# EasyEDA Pro project 智能布料.eprj

# Schematic Schematic1
Create Date: 2025-07-19; Page Name: P1; Project Name: 智能布料; Schematic Name: Schematic1; Update Date: 2025-07-20; Company: 嘉立创EDA; Page Size: A4; Version: V1.0
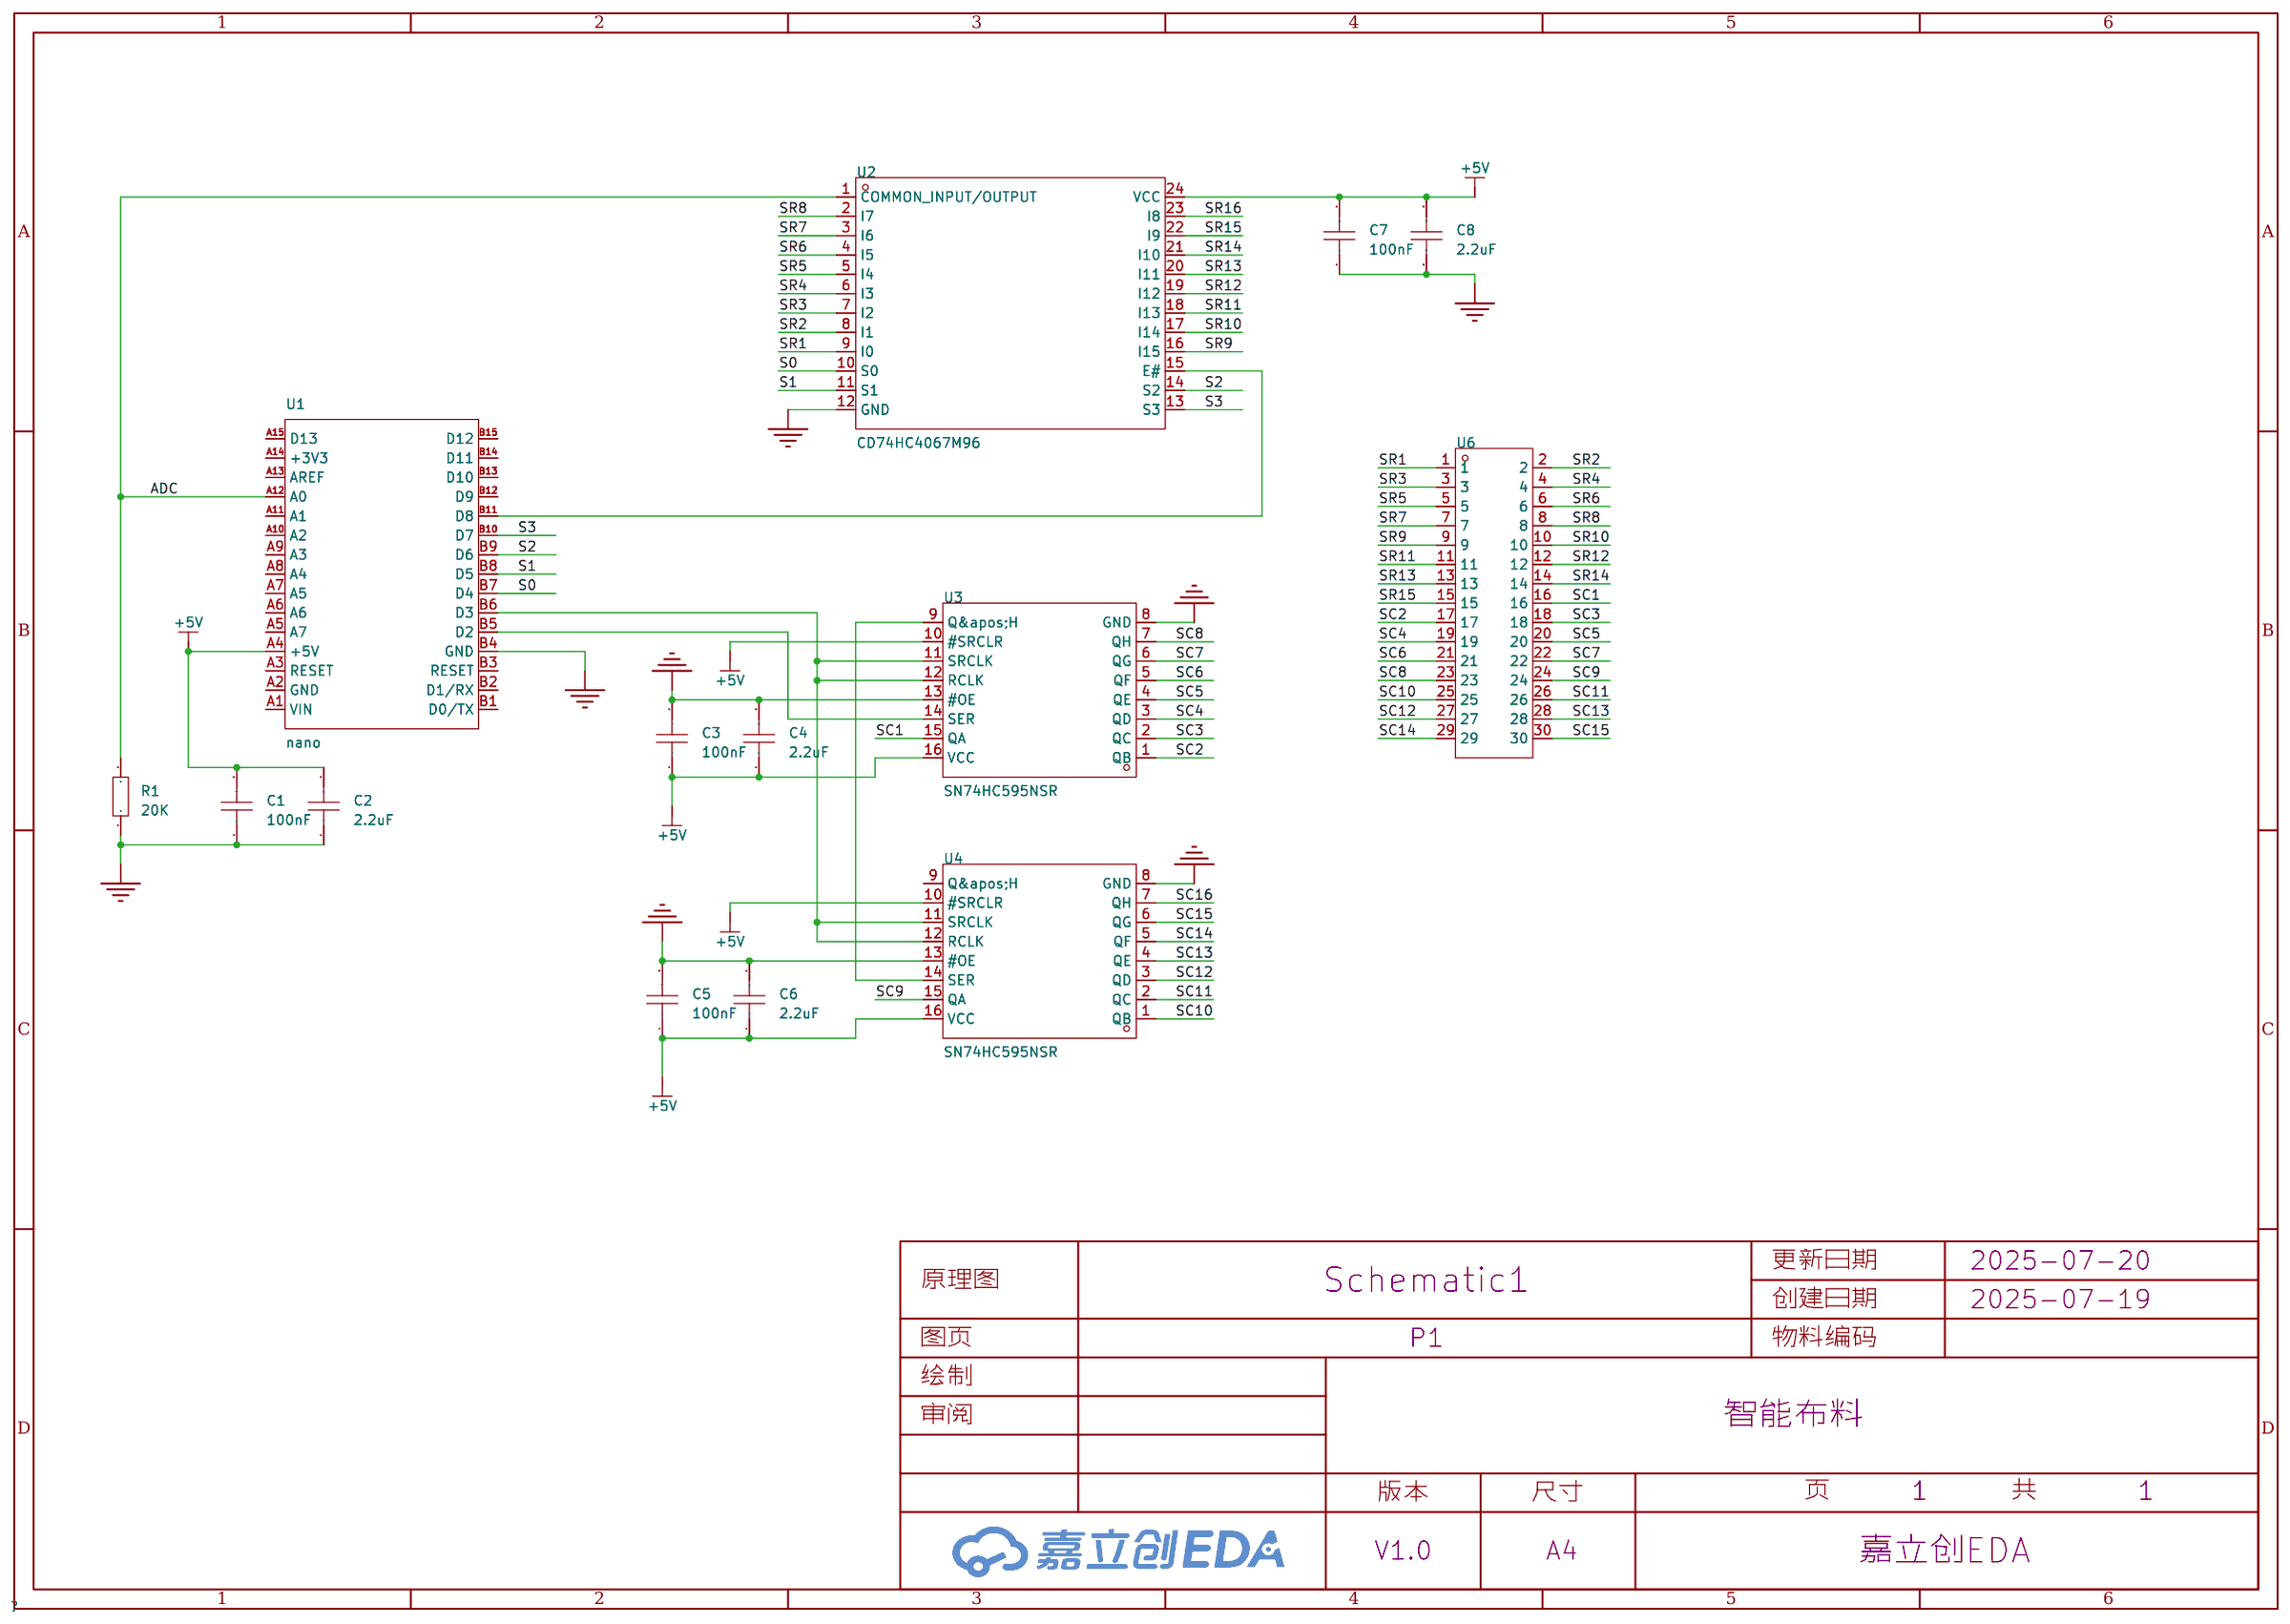
[diagram p0: schematic sheet]

## Parts
C1  100nF  [C0603]
C2  2.2uF  [C0603]
C3  100nF  [C0603]
C4  2.2uF  [C0603]
C5  100nF  [C0603]
C6  2.2uF  [C0603]
C7  100nF  [C0603]
C8  2.2uF  [C0603]
R1  20K  [R0603]
U1  nano  [arduino nano]
U2  CD74HC4067M96  [SOIC-24_L15.4-W7.5-P1.27-LS10.3-BL]
U3  SN74HC595NSR  [SOP-16_L10.0-W3.9-P1.27-LS6.0-BL]
U4  SN74HC595NSR  [SOP-16_L10.0-W3.9-P1.27-LS6.0-BL]
U6  X1270WV-2x15B-6TV01  [IDC-TH_30P-P1.27_XKB_X1270WV-2X15B-6TV01]

## Library data of the parts
C1-C8 = CAP_0603: Supplier Footprint: 0603
R1 = Res_0603: Supplier Footprint: 0603
U1 = arduino nano: LCSC Part Name: ABX00092; Supplier Part: C22392566; Manufacturer: arduino; JLCPCB Part Class: 扩展库; Datasheet: https://atta.szlcsc.com/upload/public/pdf/source/20240508/B4DB31292A327EFF3440EB84C8D7CAB2.pdf; Supplier: LCSC
U2 = CD74HC4067M96: 开关电路:-;通道数:-;导通电阻:200Ω;; LCSC Part Name: 高速CMOS逻辑16通道模拟多路复用器/解复用器; Supplier Part: C496123; Manufacturer: TI(德州仪器); Supplier Footprint: SOIC-24-300mil; JLCPCB Part Class: Extended Part; Datasheet: https://www.ti.com/cn/lit/gpn/cd74hc4067; Supplier: LCSC; Voltage - Supply: 2V~6V; Turn-on time: 83ns; RDS(on): 200Ω; Turn-off time: 83ns; Operating Temperature: -55℃~+125℃
U3 U4 = SN74HC595NSR: 功能:串行至串行或并行;工作电压:2V~6V;; LCSC Part Name: 三态输出 8位串行至串行或并行移位寄存器; Supplier Part: C191873; Manufacturer: TI(德州仪器); Supplier Footprint: SOP-16-208mil; JLCPCB Part Class: 扩展库; Datasheet: https://www.ti.com/cn/lit/gpn/sn74hc595; Supplier: LCSC; Function: 串行至串行或并行; Voltage - Supply: 2V~6V; Output Type: 三态; Operating Temperature: -40℃~+85℃
U6 = X1270WV-2x15B-6TV01: 间距:1.27mm;结构:2x15P;封装形式:直插;排数:2;每排PIN数:15;; LCSC Part Name: 1.27mm 2x15P 排数:2 每排P数:15; Supplier Part: C5121680; Manufacturer: XKB Connection(中国星坤); Supplier Footprint: 插件,P=1.27mm; JLCPCB Part Class: Extended Part; Datasheet: https://atta.szlcsc.com/upload/public/pdf/source/20220728/F198054EA0E54C242B09ED8E4ADC3E21.pdf; Supplier: LCSC; Pitch: 1.27mm; Structure: 2x15P; Holder Type: 直插; Number of Rows: 2; Pin Number in each Row: 15

## Nets
+5V: C1.2 C2.2 C3.1 C4.1 C5.1 C6.1 C7.2 C8.2 U1.A4(+5V) U2.24(VCC) U3.10(#SRCLR) U3.16(VCC) U4.10(#SRCLR) U4.16(VCC)
GND: C1.1 C2.1 C3.2 C4.2 C5.2 C6.2 C7.1 C8.1 R1.1 U1.B4(GND) U2.12(GND) U3.8(GND) U3.13(#OE) U4.8(GND) U4.13(#OE)
ADC: R1.2 U1.A12(A0) U2.1(COMMON INPUT/OUTPUT)
S0: U1.B7(D4) U2.10(S0)
S1: U1.B8(D5) U2.11(S1)
S2: U1.B9(D6) U2.14(S2)
S3: U1.B10(D7) U2.13(S3)
SC1: U3.15(QA) U6.16
SC2: U3.1(QB) U6.17
SC3: U3.2(QC) U6.18
SC4: U3.3(QD) U6.19
SC5: U3.4(QE) U6.20
SC6: U3.5(QF) U6.21
SC7: U3.6(QG) U6.22
SC8: U3.7(QH) U6.23
SC9: U4.15(QA) U6.24
SC10: U4.1(QB) U6.25
SC11: U4.2(QC) U6.26
SC12: U4.3(QD) U6.27
SC13: U4.4(QE) U6.28
SC14: U4.5(QF) U6.29
SC15: U4.6(QG) U6.30
SC16: U4.7(QH)
SR1: U2.9(I0) U6.1
SR2: U2.8(I1) U6.2
SR3: U2.7(I2) U6.3
SR4: U2.6(I3) U6.4
SR5: U2.5(I4) U6.5
SR6: U2.4(I5) U6.6
SR7: U2.3(I6) U6.7
SR8: U2.2(I7) U6.8
SR9: U2.16(I15) U6.9
SR10: U2.17(I14) U6.10
SR11: U2.18(I13) U6.11
SR12: U2.19(I12) U6.12
SR13: U2.20(I11) U6.13
SR14: U2.21(I10) U6.14
SR15: U2.22(I9) U6.15
SR16: U2.23(I8)
$1N2557: U1.B11(D8) U2.15(E#)
$1N2654: U1.B6(D3) U3.11(SRCLK) U3.12(RCLK) U4.11(SRCLK) U4.12(RCLK)
$1N2685: U1.B5(D2) U3.14(SER)
$1N2754: U3.9(Q&apos;H) U4.14(SER)

Not connected (* = marked no-connect by the designer): U1 A1(VIN) A2(GND) A3(RESET) A5(A7) A6 A7(A5) A8(A4) A9(A3) A10(A2) A11(A1) A13(AREF) A14(+3V3) A15(D13) B1(D0/TX) B2(D1/RX) B3(RESET) B12(D9) B13(D10) B14(D11) B15(D12); U4 9(Q&apos;H)

# Board PCB1
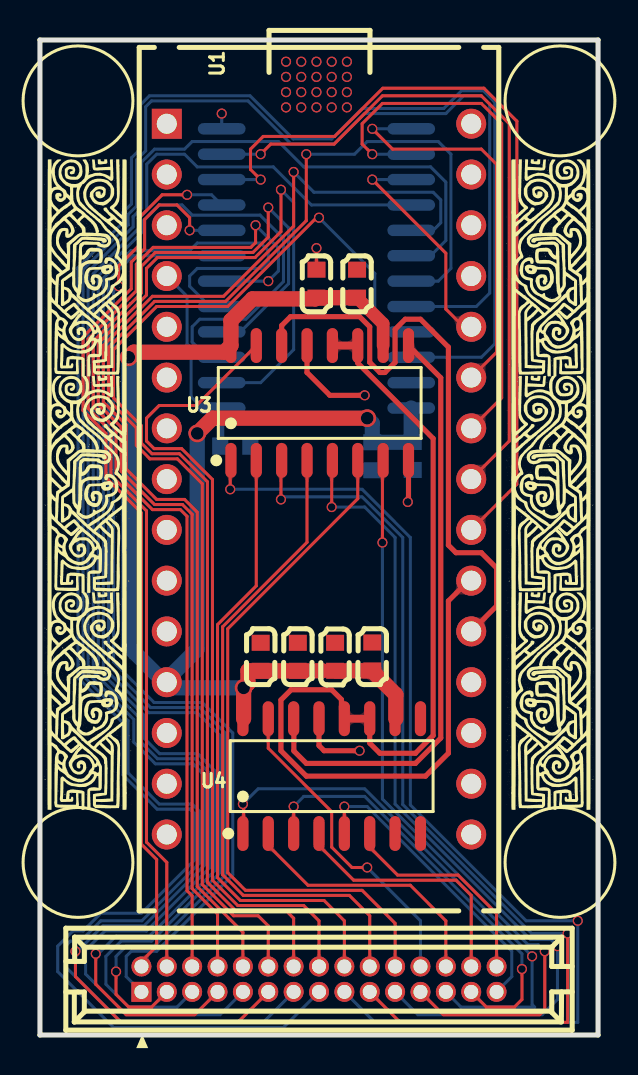
[diagram p1: board, top side]
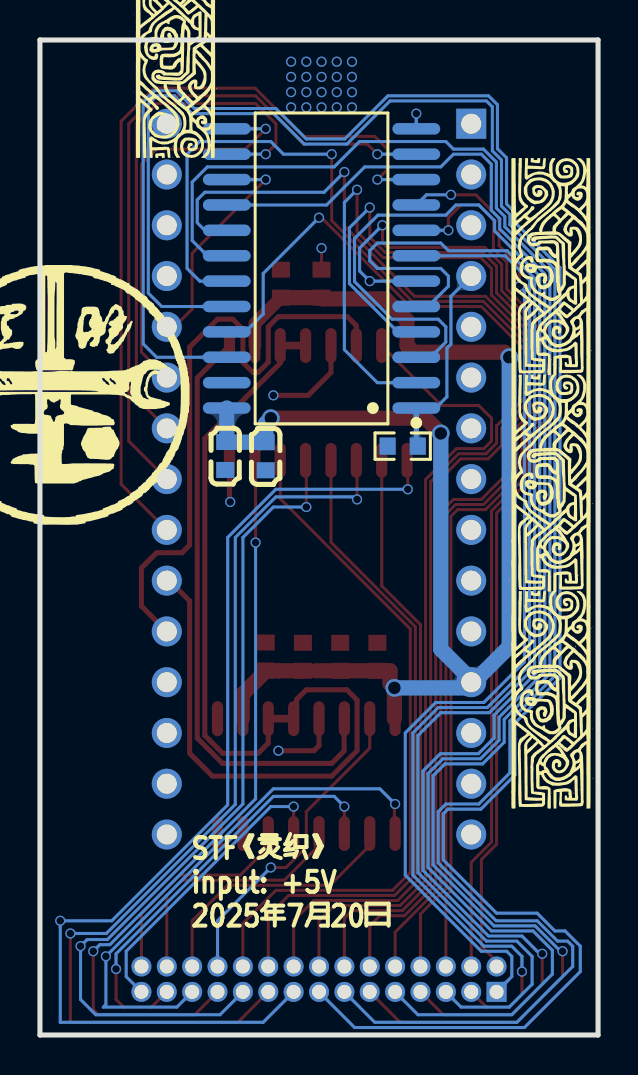
[diagram p2: board, bottom side, seen from below]

Outline 27.94 x 49.78 mm; copper layers: Top Layer, Bottom Layer. Coordinates in mm from the lower left corner of the outline.
Outline path: 0,49.78 0,0 27.94,0 27.94,49.78 0,49.78
Stack: Top Layer 0.035mm / Dielectric1 1.51mm FR4 er 4.5 / Bottom Layer 0.035mm

## Design rules (mm)
template: 自定义配置
spacing copperThickness1oz (default): track to track 0.102, other pairs 0.1 to 0.3
spacing copperThickness2oz: track to track 0.203, other pairs 0.152 to 0.3
track width copperThickness1oz (default): min 0.127, default 0.254, max 2.54
track width copperThickness2oz: min 0.203, default 0.254, max 2.54
differential pair differentialPair (default): width min 0.127, default 0.254, max 2.54; gap min 0.152, default 0.152
via viaSize (default): diameter min 0.5, default 0.61, max 10; hole min 0.3, default 0.305, max 6.3

## Placement (name value [footprint] x y rotation side)
C1  100nF  [C0603]  11.05 18.92 270 top
C2  2.2uF  [C0603]  12.91 18.92 270 top
C3  100nF  [C0603]  13.84 37.59 90 top
C4  2.2uF  [C0603]  15.88 37.59 90 top
C5  100nF  [C0603]  14.78 18.92 90 top
C6  2.2uF  [C0603]  16.64 18.94 90 top
C7  100nF  [C0603]  18.66 28.97 90 bottom
C8  2.2uF  [C0603]  16.64 28.96 90 bottom
R1  20K  [R0603]  9.78 29.46 180 bottom
U1  nano  [arduino nano]  13.97 27.81 90 top
U2  CD74HC4067M96  [SOIC-24_L15.4-W7.5-P1.27-LS10.3-BL]  13.84 38.35 90 bottom
U3  SN74HC595NSR  [SOP-16_L10.0-W3.9-P1.27-LS6.0-BL]  14.01 31.62 0 top
U4  SN74HC595NSR  [SOP-16_L10.0-W3.9-P1.27-LS6.0-BL]  14.6 12.95 0 top
U6  X1270WV-2x15B-6TV01  [IDC-TH_30P-P1.27_XKB_X1270WV-2X15B-6TV01]  13.97 2.79 0 top

## Footprints (pads in the part's own frame, mm; a bottom-side part is the same pattern mirrored in y, then rotated)
arduino nano
  round 1.5 hole 1: A1(-17.78,7.62) A2(-15.24,7.62) A3(-12.7,7.62) A4(-10.16,7.62) A5(-7.62,7.62) A6(-5.08,7.62) A7(-2.54,7.62) A8(0,7.62) A9(2.54,7.62) A10(5.08,7.62) A11(7.62,7.62) A12(10.16,7.62) A13(12.7,7.62) A14(15.24,7.62) B1(-17.78,-7.62) B2(-15.24,-7.62) B3(-12.7,-7.62) B4(-10.16,-7.62) B5(-7.62,-7.62) B6(-5.08,-7.62) B7(-2.54,-7.62) B8(0,-7.62) B9(2.54,-7.62) B10(5.08,-7.62) B11(7.62,-7.62) B12(10.16,-7.62) B13(12.7,-7.62) B14(15.24,-7.62) B15(17.78,-7.62)
  rect 1.5x1.5 hole 1: A15(17.78,7.62)
C0603
  rect 0.8x0.9 smd: 1(-0.7,0) 2(0.7,0)
IDC-TH_30P-P1.27_XKB_X1270WV-2X15B-6TV01
  rect 1x1 hole 0.7: 1(-8.89,-0.635)
  round 1 hole 0.7: 2(-8.89,0.635) 3(-7.62,-0.635) 4(-7.62,0.635) 5(-6.35,-0.635) 6(-6.35,0.635) 7(-5.08,-0.635) 8(-5.08,0.635) 9(-3.81,-0.635) 10(-3.81,0.635) 11(-2.54,-0.635) 12(-2.54,0.635) 13(-1.27,-0.635) 14(-1.27,0.635) 15(0,-0.635) 16(0,0.635) 17(1.27,-0.635) 18(1.27,0.635) 19(2.54,-0.635) 20(2.54,0.635) 21(3.81,-0.635) 22(3.81,0.635) 23(5.08,-0.635) 24(5.08,0.635) 25(6.35,-0.635) 26(6.35,0.635) 27(7.62,-0.635) 28(7.62,0.635) 29(8.89,-0.635) 30(8.89,0.635)
R0603
  rect 0.806x0.864 smd: 1(-0.753,0) 2(0.753,0)
SOIC-24_L15.4-W7.5-P1.27-LS10.3-BL
  oval 0.574x2.388 smd: 1(-6.985,-4.744) 2(-5.715,-4.744) 3(-4.445,-4.744) 4(-3.175,-4.744) 5(-1.905,-4.744) 6(-0.635,-4.744) 7(0.635,-4.744) 8(1.905,-4.744) 9(3.175,-4.744) 10(4.445,-4.744) 11(5.715,-4.744) 12(6.985,-4.744) 13(6.985,4.744) 14(5.715,4.744) 15(4.445,4.744) 16(3.175,4.744) 17(1.905,4.744) 18(0.635,4.744) 19(-0.635,4.744) 20(-1.905,4.744) 21(-3.175,4.744) 22(-4.445,4.744) 23(-5.715,4.744) 24(-6.985,4.744)
SOP-16_L10.0-W3.9-P1.27-LS6.0-BL
  oval 0.56x1.745 smd: 1(-4.445,-2.873) 2(-3.175,-2.873) 3(-1.905,-2.873) 4(-0.635,-2.873) 5(0.635,-2.873) 6(1.905,-2.873) 7(3.175,-2.873) 8(4.445,-2.873) 9(4.445,2.873) 10(3.175,2.873) 11(1.905,2.873) 12(0.635,2.873) 13(-0.635,2.873) 14(-1.905,2.873) 15(-3.175,2.873) 16(-4.445,2.873)

## Nets
As in the schematic.

Pads without a net: U1 A1 A2 A3 A5 A6 A7 A8 A9 A10 A11 A13 A14 A15 B1 B2 B3 B12 B13 B14 B15; U4 9

## Via types
v1: diameter 0.889, hole 0.635, Top Layer to Bottom Layer, 4 vias
v2: diameter 0.508, hole 0.381, Top Layer to Bottom Layer, 57 vias

## Routing (per net, layer and track width the routed paths; a pad name or vN(x,y) marks a point on that pad's centre or on a via; arc(x,y) is an arc through that point)
+5V: length 75.4
  Top Layer w0.635: U3.10 17.18,35.59 C4.1
  Top Layer w0.762: v1(16.38,30.86) 8.64,30.86 v1(7.87,30.1) ; v1(4.44,33.91) 4.7,34.16 9.23,34.16 U3.16 9.56,35.75 10.64,36.83 13.78,36.83 C3.1 C4.1 ; 10.2,15.83 v1(10.2,17.37) 10.41,17.59 10.41,18.22 C1.2 C2.2 14.14,18.22 ; 15.99,18.22 16,18.24 ; 15.99,18.22 16.62,18.22 17.82,17.03 17.82,15.83 ; 15.99,18.22 C5.1
  Bottom Layer w0.762: 6.22,17.65 4.44,19.43 v1(4.44,33.91) ; 6.22,17.65 6.51,17.37 v1(10.2,17.37) ; 6.22,17.65 7.87,19.3 v1(7.87,30.1) ; v1(16.38,30.86) 16.64,30.61 C8.2 18.65,29.66 C7.2 18.59,29.75 U2.24
GND: length 12.1
  Top Layer w0.152: C3.2 v2(13.84,39.37)
  Top Layer w0.254: 13.97,15.73 13.97,14.48 14.22,14.22 v2(16,14.22) ; U3.13 13.37,33.15 14.51,32 v2(16.26,32) ; v2(18.41,26.67) 18.45,26.67 U3.8
  Bottom Layer w0.152: U2.12 v2(9.1,46.1)
  vias: v2(12.32,48.7) v2(12.32,47.94) v2(12.32,47.17) v2(12.32,46.41) v2(13.08,48.7) v2(13.08,47.94) v2(13.08,47.17) v2(13.08,46.41) v2(13.84,48.7) v2(13.84,47.94) v2(13.84,47.17) v2(13.84,46.41) v2(14.6,48.7) v2(14.6,47.94) v2(14.6,47.17) v2(14.6,46.41) v2(15.37,48.7) v2(15.37,47.94) v2(15.37,47.17) v2(15.37,46.41)
ADC: length 10.2
  Bottom Layer w0.152: U1.A12 7.37,36.96 7.37,34.57 7.57,34.36 7.57,31.93 8.13,31.37 U2.1
  Bottom Layer w0.254: U2.1 9.1,29.54 R1.2
S0: length 40.4
  Top Layer w0.152: v2(11.05,42.8) 10.54,43.31 10.54,44.32 11.18,44.96 14.75,44.96 17.17,47.37 22.22,47.37 23.88,45.72 23.88,27.56 U1.B7
  Bottom Layer w0.152: U2.10 v2(11.05,42.8)
S1: length 34.8
  Top Layer w0.152: v2(11.05,44.07) 11.56,44.58 14.73,44.58 17.15,46.99 22.1,46.99 23.5,45.59 23.5,29.72 U1.B8
  Bottom Layer w0.152: U2.11 v2(11.05,44.07)
S2: length 27.4
  Top Layer w0.152: U1.B9 23.11,31.88 23.11,45.59 22.1,46.61 17.15,46.61 16.13,45.59 16.13,44.58 v2(16.64,44.07)
  Bottom Layer w0.152: U2.14 v2(16.64,44.07)
S3: length 20.1
  Top Layer w0.152: U1.B10 22.86,34.16 22.86,43.56 22.1,44.32 17.65,44.32 v2(16.64,45.34)
  Bottom Layer w0.152: U2.13 v2(16.64,45.34)
SC1: length 40.8
  Top Layer w0.152: U3.15 7.83,31.5 5.97,31.5 5.33,30.86 5.33,29.72 5.72,29.34 7.09,29.34 8.64,27.79 8.64,7.75 9.91,6.48 13.21,6.48 13.97,5.71 U6.16
SC2: length 53
  Top Layer w0.152: v2(9.53,27.3) 9.53,28.71 U3.1
  Bottom Layer w0.152: v2(9.53,27.3) 16.13,27.3 18.54,24.89 18.54,11.51 24.34,5.71 v2(26.92,5.71) 26.92,0.63 16.76,0.63 U6.17
SC3: length 31.2
  Top Layer w0.152: U6.18 15.24,5.71 14.22,6.73 10.03,6.73 8.89,7.87 8.89,20.53 10.83,22.47 U3.2
SC4: length 48.2
  Top Layer w0.152: U3.3 12.06,28.71 v2(12.06,26.8) ; v2(26.42,5.08) 26.42,0.63 18.03,0.63 U6.19
  Bottom Layer w0.152: v2(12.06,26.8) 12.19,26.92 16.13,26.92 18.16,24.89 18.16,11.54 24.62,5.08 v2(26.42,5.08)
SC5: length 33.2
  Top Layer w0.152: U6.20 16.51,5.97 15.49,6.98 10.18,6.98 9.14,8.02 9.14,20.43 13.37,24.65 U3.4
SC6: length 42.1
  Top Layer w0.152: v2(14.6,26.42) 14.6,28.71 U3.5
  Bottom Layer w0.152: U6.21 18.92,1.02 25.15,1.02 25.91,1.78 v2(25.91,4.44) 25.58,4.78 24.56,4.78 17.78,11.56 17.78,24.89 16.26,26.42 v2(14.6,26.42)
SC7: length 34.9
  Top Layer w0.152: U6.22 17.78,5.59 16.13,7.24 10.29,7.24 9.4,8.13 9.4,20.32 15.91,26.83 U3.6
SC8: length 38
  Top Layer w0.152: v2(17.15,24.64) 17.15,28.71 U3.7 ; U6.23 20.19,1.02 25.02,1.02 25.27,1.27 v2(25.27,4.19)
  Bottom Layer w0.152: v2(17.15,24.64) 17.15,11.81 24.44,4.52 24.94,4.52 v2(25.27,4.19)
SC9: length 15.9
  Top Layer w0.152: 16.26,8.38 15.62,8.38 14.6,9.4 14.6,11.18 11.43,14.35 11.43,15.83
  Bottom Layer w0.152: U6.24 19.05,5.71 v2(16.38,8.38)
SC10: length 27.7
  Top Layer w0.152: v2(10.16,11.56) 10.2,11.52 10.2,9.45
  Bottom Layer w0.152: v2(10.16,11.56) 10.92,12.32 16.26,12.32 v2(24.64,3.94) 24.64,1.52 24.77,1.4 21.08,1.4 U6.25
SC11: length 13.3
  Top Layer w0.152: 11.43,10.08 11.43,9.48 13.42,7.49 18.54,7.49 20.32,5.71 U6.26
SC12: length 21.5
  Top Layer w0.152: v2(24.13,3.3) 24.13,1.78 23.75,1.4 22.35,1.4 U6.27 ; U4.3 v2(12.7,11.43)
  Bottom Layer w0.152: v2(12.7,11.43) 13.21,11.94 16.26,11.94 24.13,4.06 v2(24.13,3.3)
SC13: length 12.8
  Top Layer w0.152: U6.28 21.59,6.98 20.83,7.75 15.71,7.75 13.97,9.48 U4.4
SC14: length 15.1
  Top Layer w0.152: U4.5 v2(15.24,11.43)
  Bottom Layer w0.152: v2(15.24,11.43) 16.38,11.43 23.62,4.19 23.62,2.92 U6.29
SC15: length 11.1
  Top Layer w0.152: U4.6 16.51,9.52 16.45,9.46 17.91,8 20.93,8 22.86,6.07 U6.30
SR1: length 51.2
  Top Layer w0.152: v2(3.94,37.46) 3.94,38.48 4.95,39.5 4.95,40.77 4.98,40.8 4.98,40.9 6.12,42.04 v2(7.37,42.04)
  Bottom Layer w0.152: U2.9 8.59,42.04 v2(7.37,42.04) ; v2(3.94,37.46) 3.68,37.21 3.68,18.67 5.72,16.64 8.13,16.64 9.65,15.11 9.65,8 5.84,4.19 4.57,4.19 4.32,3.94 4.32,2.92 U6.1
SR2: length 45.5
  Top Layer w0.152: U6.2 5.08,3.68 5.84,4.44 5.84,8.78 5.08,9.55 5.08,26.12 3.3,27.9 3.3,30.1 2.16,31.24 2.16,34.92 4.57,37.34 4.57,38.67 5.24,39.34 5.24,40.8 5.97,41.53 6.86,41.53 7.49,40.89 v2(7.49,40.26)
  Bottom Layer w0.152: U2.8 v2(7.49,40.26)
SR3: length 52
  Top Layer w0.152: U6.3 5.59,1.4 4.44,1.4 3.81,2.03 v2(3.81,3.17)
  Bottom Layer w0.152: U2.7 4.66,38.99 3.43,37.76 3.43,18.5 5.55,16.38 8,16.38 9.27,15.11 9.27,8 5.72,4.44 4.32,4.44 3.81,3.94 v2(3.81,3.17)
SR4: length 50.9
  Top Layer w0.152: U6.4 6.35,8.64 5.33,9.65 5.33,26.23 3.56,28 3.56,30.21 2.41,31.35 2.41,34.82 4.82,37.23 4.82,38.56 5.67,39.41 10.56,39.41 10.8,39.64 v2(10.8,40.51)
  Bottom Layer w0.152: U2.6 v2(11.43,37.72) 11.94,38.23 11.94,39.37 v2(10.8,40.51)
SR5: length 64
  Bottom Layer w0.152: U6.5 6.86,1.4 4.44,1.4 3.3,2.54 3.3,3.94 4.06,4.7 5.59,4.7 9.02,8.13 9.02,14.98 7.87,16.13 5.44,16.13 3.18,18.39 3.18,37.87 4.55,39.24 7.49,39.24 7.87,39.62 11.05,39.62 11.43,39.24 11.43,38.73 11.05,38.35 7.87,38.35 7.49,37.97 7.49,37.46 8.51,36.45 U2.5
SR6: length 55.9
  Top Layer w0.152: U6.6 7.62,6.96 7.36,7.22 7.36,25.95 7.03,26.29 5.63,26.29 3.81,28.11 3.81,30.31 2.67,31.45 2.67,34.71 5.08,37.13 5.08,38.46 5.77,39.15 10.66,39.15 11.43,39.92 v2(11.43,41.4)
  Bottom Layer w0.152: U2.4 10.03,35.18 12.45,37.59 12.45,40.39 v2(11.43,41.4)
SR7: length 71.7
  Top Layer w0.152: 8.89,2.16 7.75,1.02 4.32,1.02 2.79,2.54 v2(2.79,4.06)
  Bottom Layer w0.152: v2(2.79,4.06) 2.92,4.06 3.81,4.95 5.48,4.95 8.76,8.23 8.76,13.21 7.9,14.08 5.99,14.08 5.21,14.86 5.21,16 2.92,18.29 2.92,37.97 5.18,40.23 5.18,40.74 5.97,41.53 7.11,41.53 7.62,41.02 11.02,41.02 12.19,39.85 12.19,37.7 10.31,35.81 8,35.81 7.62,35.43 7.62,34.67 8.38,33.91 U2.3
SR8: length 61.4
  Top Layer w0.152: 8.89,3.43 8.89,6.05 7.62,7.33 7.62,26.06 7.13,26.54 5.74,26.54 4.06,28.22 4.06,30.42 2.92,31.56 2.92,34.61 5.33,37.02 5.33,38.35 5.88,38.9 10.77,38.9 12.06,40.19 v2(12.06,42.29)
  Bottom Layer w0.152: U2.2 11.05,32.64 12.7,34.29 12.7,41.66 v2(12.06,42.29)
SR9: length 72.6
  Bottom Layer w0.152: U6.9 9.02,1.02 4.32,1.02 2.29,3.05 2.29,4.24 3.25,5.21 5.33,5.21 8.51,8.38 8.51,13.08 7.77,13.82 5.88,13.82 4.95,14.75 4.95,15.9 2.67,18.18 2.67,38.08 4.92,40.33 4.92,40.84 5.34,41.26 5.34,43.57 5.84,44.07 7.24,44.07 7.87,43.43 11.68,43.43 13.59,41.53 U2.16
SR10: length 60.2
  Top Layer w0.152: U6.10 10.16,5.14 7.87,7.43 7.87,26.16 7.24,26.8 5.84,26.8 4.32,28.32 4.32,30.52 3.17,31.67 3.17,34.5 5.63,36.96 9.19,36.96 12.7,40.47 v2(12.7,43.18)
  Bottom Layer w0.152: v2(12.7,43.18) 13.72,42.16 19.69,42.16 20.07,41.78 20.07,40.64 19.69,40.26 U2.17
SR11: length 82
  Top Layer w0.152: U6.11 9.91,0.63 4.06,0.63 1.78,2.92 v2(1.78,4.19)
  Bottom Layer w0.152: U2.18 19.56,38.99 20.32,39.75 20.32,42.67 19.56,43.43 13.21,43.43 11.94,44.7 7.62,44.7 7.24,44.32 5.74,44.32 5.09,43.68 5.09,41.37 4.67,40.95 4.67,40.44 2.41,38.18 2.41,18.08 4.7,15.79 4.7,14.65 5.78,13.57 7.66,13.57 8.25,12.98 8.25,8.51 5.21,5.46 3.15,5.46 1.88,4.19 v2(1.78,4.19)
SR12: length 67.4
  Top Layer w0.152: v2(13.34,44.07) 13.34,40.75 9.29,36.7 5.74,36.7 3.43,34.4 3.43,31.77 4.82,30.37 4.82,29.51 5.5,28.83 6.88,28.83 8.13,27.58 8.13,7.54 9.69,5.97 10.92,5.97 11.43,5.46 U6.12
  Bottom Layer w0.152: U2.19 19.94,37.72 20.57,38.35 20.57,44.07 19.94,44.7 16.38,44.7 15.75,44.07 v2(13.34,44.07)
SR13: length 98.3
  Bottom Layer w0.152: U6.13 11.18,0.63 4.06,0.63 1.27,3.43 1.27,4.44 1.52,4.7 2.03,4.7 3.04,5.72 5.1,5.72 8,8.61 8,11.18 7.62,11.56 5.97,11.56 4.41,13.11 4.41,15.72 2.16,17.97 2.16,38.29 4.41,40.54 4.41,41.05 4.84,41.47 4.84,43.78 5.29,44.24 5.29,46.44 5.59,46.74 10.41,46.74 12.57,44.58 14.71,44.58 16.23,46.1 20.32,46.1 21.21,46.99 22.1,46.99 22.52,46.57 22.52,37.12 21.84,36.45 U2.20
SR14: length 58.1
  Top Layer w0.152: U6.14 12.7,5.84 12.32,6.22 9.8,6.22 8.38,7.64 8.38,27.69 6.99,29.08 5.61,29.08 5.08,29.61 5.08,30.48 3.68,31.88 3.68,34.29 5.84,36.45 9.4,36.45 13.84,40.89 v2(13.97,40.89)
  Bottom Layer w0.152: U2.21 17.65,35.18 16.76,36.07 16.76,38.1 v2(13.97,40.89)
SR15: length 104
  Bottom Layer w0.152: U6.15 12.19,0.38 3.68,0.38 0.89,3.17 0.89,4.44 1.65,5.21 2.16,5.21 3.05,6.1 5.08,6.1 7.75,8.76 7.75,11.07 7.51,11.3 5.86,11.3 4.16,13.01 4.16,15.61 1.9,17.87 1.9,38.4 4.16,40.65 4.16,41.16 4.58,41.58 4.58,43.89 5.04,44.34 5.04,46.54 5.48,46.99 10.52,46.99 12.68,44.83 14.61,44.83 16.13,46.36 20.21,46.36 21.1,47.24 22.2,47.24 22.73,46.71 22.73,46.7 22.77,46.68 22.77,34.58 22.1,33.91 U2.22
$1N2557: length 11.6
  Top Layer w0.152: U1.B11 21.21,35.43 20.32,36.32 20.32,39.12 v2(16.64,42.8)
  Bottom Layer w0.152: U2.15 v2(16.64,42.8)
$1N2654: length 53.5
  Top Layer w0.254: 16.43,15.83 16.51,15.75 16.51,14.6 17.02,14.1 18.8,14.1 19.69,14.99 19.69,29.84 15.91,33.62 U3.11 ; 21.46,22.73 20.45,21.72 20.45,14.1 19.3,12.95 13.34,12.95 12.06,14.22 12.06,16.76 12.57,17.27 14.6,17.27 15.09,16.79 15.09,16.28
  Top Layer w0.381: U3.11 U3.12 ; U4.11 U4.12
$1N2685: length 30.9
  Top Layer w0.254: U1.B5 22.86,21.46 22.86,23.37 22.1,24.13 20.83,24.13 20.45,24.51 20.45,34.42 19.05,35.81 18.29,35.81 17.78,35.31 17.78,33.65 17.27,33.15 17.02,33.15 16.51,33.65 16.51,35.43 16,35.94 12.55,35.94 12.1,35.49 U3.14
$1N2754: length 30.1
  Top Layer w0.254: U3.9 20.07,32.88 20.07,14.86 18.8,13.59 13.34,13.59 12.71,14.21 12.71,15.81 U4.14

## Copper pours and planes (outline as drawn; the poured copper is in the pictures)
GND on Top Layer: 0,49.78 27.94,49.78 27.94,0 0,0
GND on Bottom Layer: -0.13,49.91 28.07,49.91 28.07,0 -0.13,0

Small or netless copper shapes (teardrops, artwork), in the pictures only: 98 on Top Layer, 76 on Bottom Layer

## Text on the board
Bottom Silkscreen Layer: STF《灵织》 / input: +5V / 2025年7月20日
